# EAGLE design IBB v1.0 (EAGLE 7.5.0) (continued)
### Nets (continued)

### Notes on the sheet
- LEDs
- Router Connector | Sensor Connector
- LAN LED
- Programmable Button
- WAN LED
- POWER LED
- BEE Socket: 
  for BLE/GPRS/3G/4G/5G
- I/O, Connectors

## Sheet 5 of 5
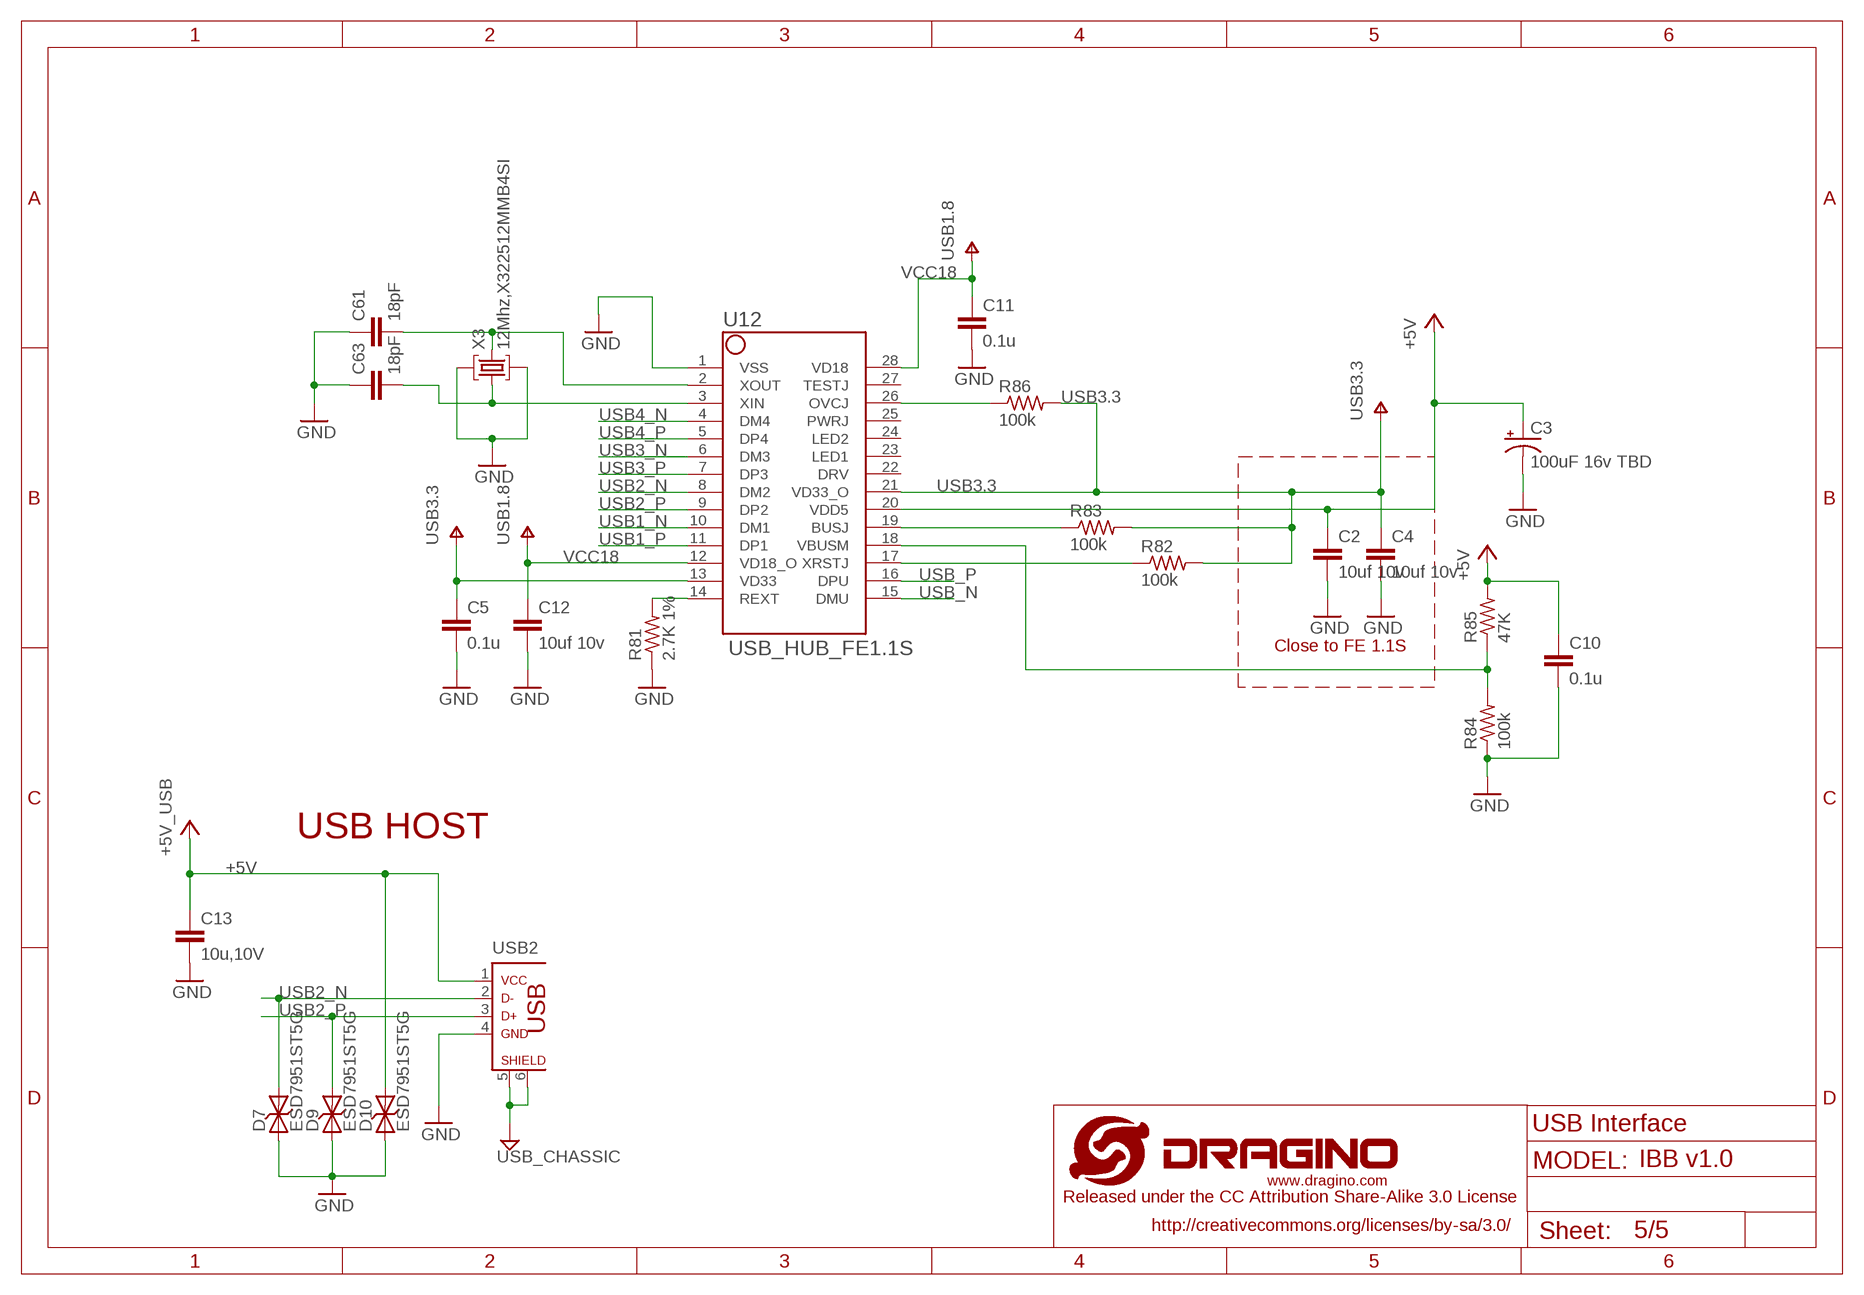
[diagram p4: schematic, sheet 5]

### Parts
C2  10uf 10v  C-EUC0603  [C0603]
C3  100uF 16v TBD  CPOL-USUD-6,3X5,8  [UD-6,3X5,8_NICHICON]
C4  10uf 10v  C-EUC0603  [C0603]
C5  0.1u  C-EUC0402  [C0402]
C10  0.1u  C-EUC0402  [C0402]
C11  0.1u  C-EUC0402  [C0402]
C12  10uf 10v  C-EUC0603  [C0603]
C13  10u,10V  C-EUC0805  [C0805]
C61  18pF  C-EUC0402  [C0402]
C63  18pF  C-EUC0402  [C0402]
D7  ESD7951ST5G  TVSSOD−923  [SOD−923]
D9  ESD7951ST5G  TVSSOD−923  [SOD−923]
D10  ESD7951ST5G  TVSSOD−923  [SOD−923]
R81  2.7K 1%  R-US_R0402  [R0402]
R82  100k  R-US_R0402  [R0402]
R83  100k  R-US_R0402  [R0402]
R84  100k  R-US_R0402  [R0402]
R85  47K  R-US_R0402  [R0402]
R86  100k  R-US_R0402  [R0402]
U12  USB_HUB_FE1.1S  [USB_HUB_FE1.1S]
USB2  USB_C42562  [USB_C42562]
X3  12Mhz,X322512MMB4SI  CRYSTAL  [SMARTPRJ_CRYSTAL-3.2-2.5]

### Nets
+5V: C2.1 C3.+ C10.1 C13.1 D10.P$2 R85.2 U12.20(VDD5) USB2.1 ; supply symbol labelled +5V_USB ; also sheet 2,4
CLK_N: C63.2 U12.3(XIN) X3.1(C1)
CLK_P: C61.2 U12.2(XOUT) X3.3(C2)
GND [gnd]: C2.2 C3.- C4.2 C5.2 C10.2 C11.2 C12.2 C13.2 C61.1 C63.1 D7.P$1 D9.P$1 D10.P$1 R81.1 R84.1 U12.1(VSS) USB2.4 X3.2(GND) X3.4(GND) ; also sheet 1,2,3,4
N$18: R86.1 U12.26(OVCJ)
N$109: R81.2 U12.14(REXT)
N$111: R82.1 U12.17(XRSTJ)
N$112: R83.1 U12.19(BUSJ)
N$113: R84.2 R85.1 U12.18(VBUSM)
USB1_N: U12.10(DM1) ; also sheet 4
USB1_P: U12.11(DP1) ; also sheet 4
USB2_N [usbtrace-4layer]: D7.P$2 U12.8(DM2) USB2.2
USB2_P [usbtrace-4layer]: D9.P$2 U12.9(DP2) USB2.3
USB3.3: C4.1 C5.1 R82.2 R83.2 R86.2 U12.13(VD33) U12.21(VD33_O)
USB3_N: U12.6(DM3) ; also sheet 4
USB3_P: U12.7(DP3) ; also sheet 4
USB4_N: U12.4(DM4)
USB4_P: U12.5(DP4)
USB_GND [gnd]: USB2.5 USB2.6 ; supply symbol labelled USB_CHASSIC
USB_N: U12.15(DMU) ; also sheet 1
USB_P: U12.16(DPU) ; also sheet 1
VCC18: C11.1 C12.1 U12.12(VD18_O) U12.28(VD18) ; supply symbol labelled USB1.8
Unconnected: U12.22(DRV) U12.23(LED1) U12.24(LED2) U12.25(PWRJ) U12.27(TESTJ)

### Notes on the sheet
- Close to FE 1.1S
- USB HOST
- USB Interface

## Power pins joined to a net without a drawn wire
OPTIONAL_ANT: U1.49(OPTIONAL_ANT)

## Library data of the parts
BEE-CON-1 BEE-CON-2 = dragino-passive:CON-10P: FEMALE HEADER
BEE-VIN USB3 = dragino:JP2E: JUMPER
C1 C6-C9 C13 C17 C19-C23 C33-C38 C52 C53 C55-C58 = dragino:C-EU: CAPACITOR, European symbol
C2 C4 C5 C10-C12 C15 C61 C63 = dragino-passive:C-EU: CAPACITOR, European symbol
C3 = dragino:CPOL-US: POLARIZED CAPACITOR, American symbol
C14 C18 = rcl:CPOL-US: POLARIZED CAPACITOR, American symbol
D7 D9 D10 = dragino:TVS: DIODE
F1 = dragino:FUSE: FUSE 5 x 20 mm
J1 = dragino:POWER_JACK: Power Jack This is the standard 5.5mm barrel jack for power. The PTH is the most common, proven, reliable, footprint. All others are experimental. The Slot footprint only works if the mill layer is transmitted to the PCB fab house so be warned. Spark Fun Electronics SKU : PRT-00119. Mating wall wart : TOL-00298 (and others)
J2 = dragino:ETHERNET_2PORT
L2 = dragino-passive:INDUCTOR: CHOKE U15
L4 L5 = inductor-neosid:BS: INDUCTOR nominal inductance, magnetically screened; OC_FARNELL: unknown; OC_NEWARK: unknown
L6 = dragino:INDUCTOR: CHOKE U15
LAN PWR SENSOR SYS WAN WIFI = dragino:LED: LED OSRAM: - CHIPLED LG R971, LG N971, LY N971, LG Q971, LY Q971, LO R971, LY R971 LH N974, LH R974 LS Q976, LO Q976, LY Q976 LO Q996 - Hyper CHIPLED LW Q18S LB Q993, LB Q99A, LB R99A - SideLED LS A670, LO A670, LY A670, LG A670, LP A670 LB A673, LV A673, LT A673, LW A673 LH A674 LY A675 LS A676, LA A676, LO A676, LY A676, LW A676 LS A679, LY A679, LG A679 - Hyper Micro SIDELED® LS Y876, LA Y876, LO Y876, LY Y876 LT Y87S - SmartLED LW L88C, LW L88S LB L89C, LB L89S, LG L890 LS L89K, LO L89K, LY L89K LS L896, LA L896, LO L896, LY L896 - TOPLED LS T670, LO T670, LY T670, LG T670, LP T670 LSG T670, LSP T670, LSY T670, LOP T670, LYG T670 LG T671, LOG T671, LSG T671 LB T673, LV T673, LT T673, LW T673 LH T674 LS T676, LA T676, LO T676, LY T676, LB T676, LH T676, LSB T676, LW T676 LB T67C, LV T67C, LT T67C, LS T67K, LO T67K, LY T67K, LW E67C LS E67B, LA E67B, LO E67B, LY E67B, LB E67C, LV E67C, LT E67C LW T67C LS T679, LY T679, LG T679 LS T770, LO T770, LY T770, LG T770, LP T770 LB T773, LV T773, LT T773, LW T773 LH T774 LS E675, LA E675, LY E675, LS T675 LS T776, LA T776, LO T776, LY T776, LB T776 LHGB T686 LT T68C, LB T68C - Hyper Mini TOPLED® LB M676 - Mini TOPLED Santana® LG M470 LS M47K, LO M47K, LY M47K Source: http://www.osram.convergy.de LUXEON: - LUMILED® LXK2-PW12-R00, LXK2-PW12-S00, LXK2-PW14-U00, LXK2-PW14-V00 LXK2-PM12-R00, LXK2-PM12-S00, LXK2-PM14-U00 LXK2-PE12-Q00, LXK2-PE12-R00, LXK2-PE12-S00, LXK2-PE14-T00, LXK2-PE14-U00 LXK2-PB12-K00, LXK2-PB12-L00, LXK2-PB12-M00, LXK2-PB14-N00, LXK2-PB14-P00, LXK2-PB14-Q00 LXK2-PR12-L00, LXK2-PR12-M00, LXK2-PR14-Q00, LXK2-PR14-R00 LXK2-PD12-Q00, LXK2-PD12-R00, LXK2-PD12-S00 LXK2-PH12-R00, LXK2-PH12-S00 LXK2-PL12-P00, LXK2-PL12-Q00, LXK2-PL12-R00 Source: www.luxeon.com KINGBRIGHT: KA-3528ASYC Source: www.kingbright.com
Q1 = dragino:NMOSFET: MOS FET; OC_FARNELL: unknown; OC_NEWARK: unknown
R1-R27 R29-R37 R39-R41 R46 R55-R57 R81-R86 = dragino:R-US_: RESISTOR, American symbol
ROUTER = dragino:MA08-2: PIN HEADER; OC_FARNELL: unknown; OC_NEWARK: unknown
S1 = dragino:PUSH_SWITCH: PUSH SWITCH ITT-Cannon-Cannon
SCREW = dragino:MA07-2: PIN HEADER; OC_FARNELL: unknown; OC_NEWARK: unknown
T1 = dragino:RJ45_TRANSFORMER_HST2038DR
T4 = zetex:NPNSOT323: NPN TRANSISTOR; MPN: DSS4160U-7; OC_FARNELL: 1710696; OC_NEWARK: 25R4558
U1 = dragino:DRAGINO_HE-4025
U2 U3 = dragino:RT7272
U5 = linear:MC33269ST*: Adjustable Output Low Dropout Voltage Regulator 800 mA Source: http://www.onsemi.com/pub/Collateral/MC33269-D.PDF
U6 = dragino:NC7WZ125: 3 state buffer: http://www.fairchildsemi.com/ds/NC/NC7WZ125.pdf
U12 = dragino:USB_HUB_FE1.1S
USB2 = dragino-passive:USB_C42562
X1 X2 = con-phoenix-350:1751293: MKDS 1/ 7-3,5 Printklemme Nennstrom: 10 A Bemessungsspannung: 160 V Raster: 3,5 mm Polzahl: 7 Montageart: Löten Anschlussart: Schraubanschluss Anschlussrichtung vom Leiter zur Platine: 0° Source: http://eshop.phoenixcontact.com .. 1751293.pdf; OC_FARNELL: unknown; OC_NEWARK: unknown
X3 = dragino-passive:CRYSTAL

## Net classes
0 default: clearance 0.205 mm
1 power: width 0.61 mm, drill 0.406 mm, clearance 0.254 mm
2 gnd: width 0.305 mm, drill 0.33 mm, clearance 0.254 mm
3 usbvcc: width 0.508 mm, drill 0.61 mm, clearance 0.254 mm
4 aref: width 0.406 mm, drill 0.61 mm, clearance 0.254 mm
6 usbtrace-4layer: width 0.191 mm, clearance 0.203 mm

## Board
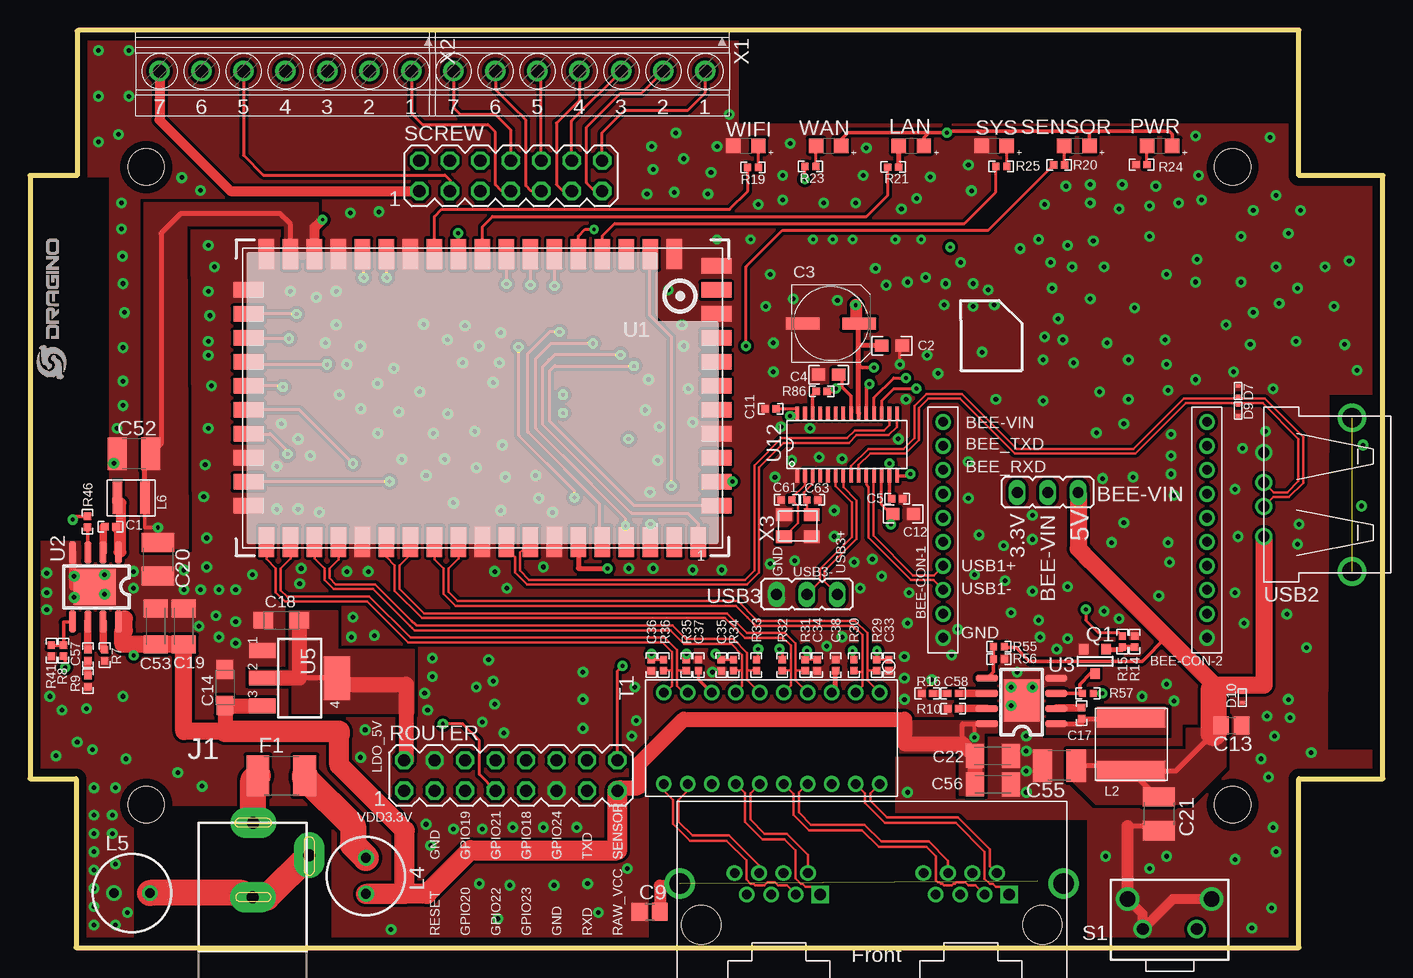
[diagram p5: board, top side]
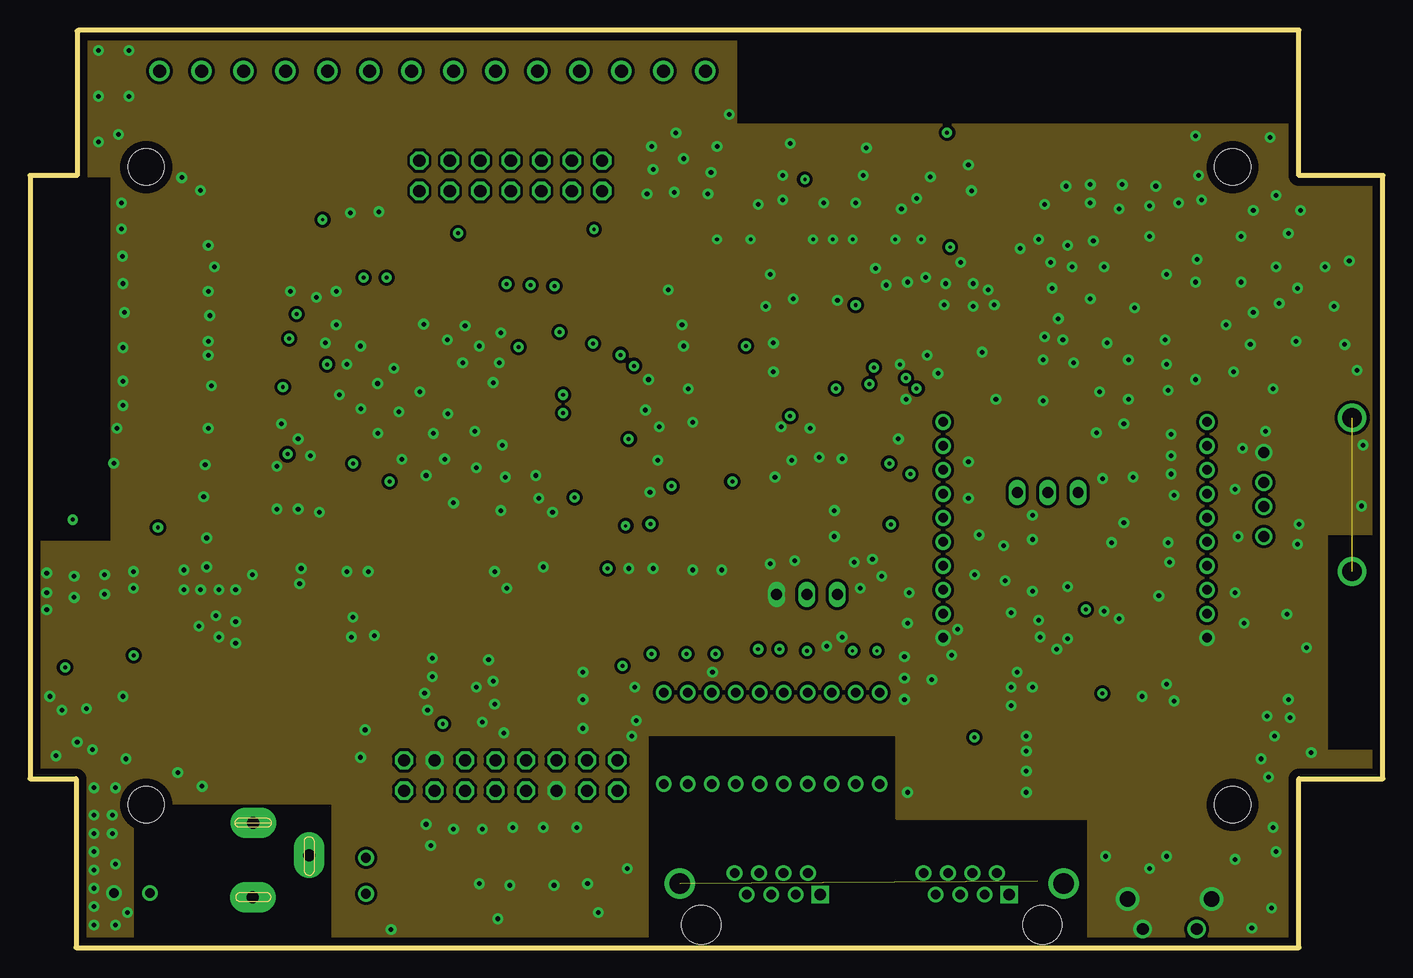
[diagram p6: board, inner layer Route2]
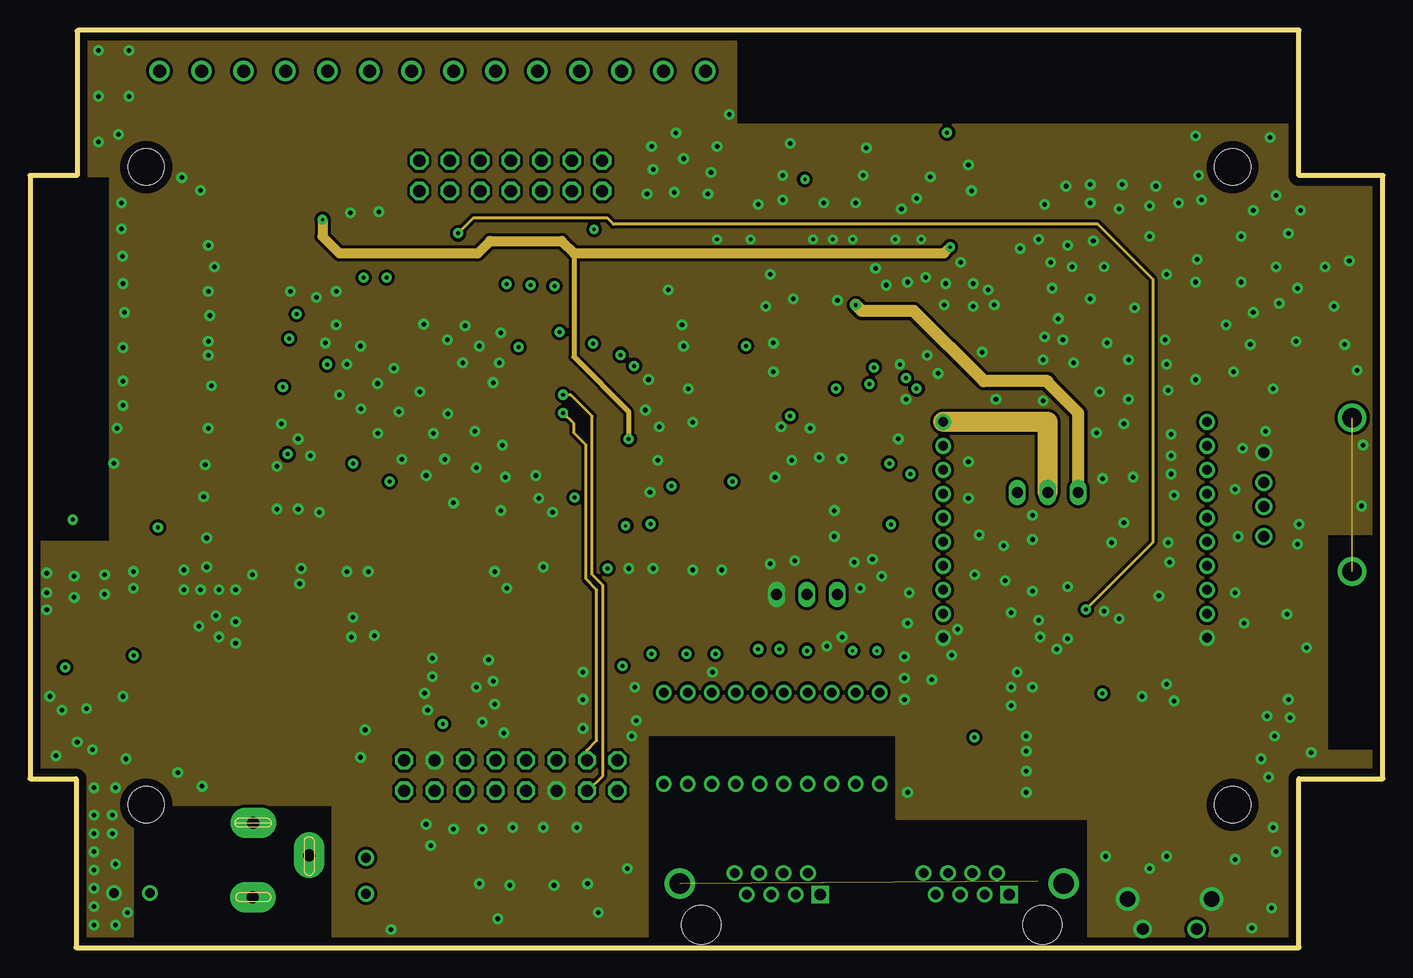
[diagram p7: board, inner layer Route15]
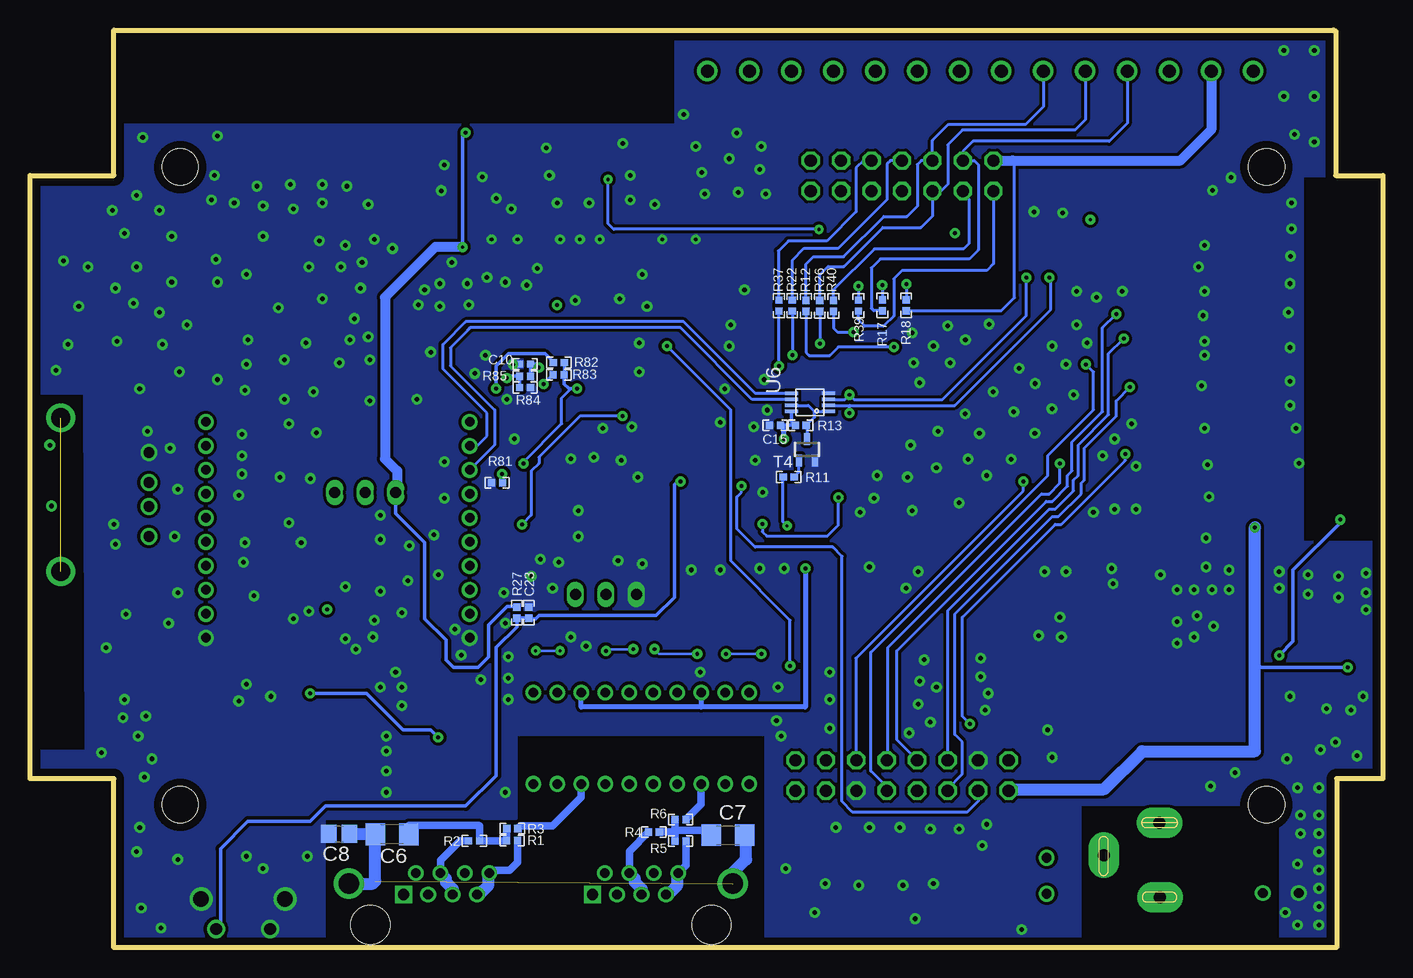
[diagram p8: board, bottom side, seen from below]

Size 112.78 x 76.5 mm. Coordinates in mm from the lower left corner, seen from the top.
Outline: 105.79,0 105.79,14.08 112.78,14.08 112.78,64.37 105.79,64.37 105.79,76.5 4.1,76.5 4.1,76.44 3.94,76.44 3.94,64.37 0,64.37 0,14.08 3.85,14.08 3.85,0 105.79,0
Copper layers (1*2+15*16): Top 0.035mm / dielectric 1.5mm / Route2 0.035mm / dielectric 0.15mm / Route15 0.035mm / dielectric 0.2mm / Bottom 0.035mm
Design rules "default *": minimum track width 5mil, minimum drill 10mil, track to track 8mil, track to pad 8mil, pad to pad 8mil, via to via 10mil, smd to smd 8mil, copper to edge 26mil, drill to drill 10mil, minimum pad ring 10mil, minimum via ring 10mil, stop-mask expansion 1mil, vias tented up to drill 30mil, thermal gap 10mil
Holes 3 mm at 100.25,11.91 9.7,11.91 9.7,65.08 100.25,65.08
bRestrict: area 98.9,70.3 to 105,75.9

### Footprints (pad centres in the part's own frame; a part is rotated, then mirrored left to right if it is on the bottom)
10P-2.0MM = drill 0.8 pad 1.27: 1 0,9; 2 0,7; 3 0,5; 4 0,3; 5 0,1; 6 0,-1; 7 0,-3; 8 0,-5; 9 0,-7; 10 0,-9
JP2 = drill 0.914 long: 1 -2.54,0; 2 0,0; 3 2.54,0
C0402 = smd 0.61 x 0.61: 1 -0.457,0; 2 0.457,0
C0603 = smd 1.1 x 1: 1 -0.85,0; 2 0.85,0
UD-6,3X5,8_NICHICON = smd 2.8 x 1: + 2.35,0; - -2.35,0
C1206 = smd 1.6 x 1.8: 1 -1.4,0; 2 1.4,0
C0805 = smd 1.3 x 1.5: 1 -0.85,0; 2 0.85,0
SMC_A = smd 1.6 x 1.4: + -1.5,0; - 1.5,0
C1206K = smd 1.5 x 2: 1 -1.5,0; 2 1.5,0
C1210 = smd 1.6 x 2.7: 1 -1.4,0; 2 1.4,0
SOD−923 = smd 0.3 x 0.4: P$1 -0.45,0; P$2 0.45,0
L1812 = smd 1.9 x 3.4: 1 -1.95,0; 2 1.95,0
POWER_JACK_SLOT = drill 1 pad 2.54 long: GND@1 0,0; GND@2 4.7,3.5; PWR 0.04,6.2
ETHERNET-1X2 = drill 0.94 pad 1.27 square: 1-1 4.305,-2.54; 2-1 -11.445,-2.54 | drill 0.8: 1-2 5.325,-4.32; 1-3 6.345,-2.54; 1-4 7.365,-4.32; 1-5 8.385,-2.54; 1-6 9.405,-4.32; 1-7 10.425,-2.54; 1-8 11.445,-4.32; 2-2 -10.425,-4.32; 2-3 -9.405,-2.54; 2-4 -8.385,-4.32; 2-5 -7.365,-2.54; 2-6 -6.345,-4.32; 2-7 -5.325,-2.54; 2-8 -4.305,-4.32 | drill 1.7: S1 16,-3.43; S2 -16,-3.43 | hole 3.25: -14.225,0; 14.225,0
SWPA6028S = smd 5.7 x 1.7: P$1 0,2.25; P$2 0,-2.25
BS11 = drill 0.8: 1 -1.5,0; 2 1.5,0
SWPA3010S = smd 0.8 x 2.7: P$1 -1.15,0; P$2 1.15,0
CHIP-LED0805 = smd 1.2 x 1.2: A 0,-1.05; C 0,1.05
SOT-23 = smd 0.787 x 0.889: 1 0,-1.016; 2 -0.95,1.016; 3 0.95,1.016
R0402 = smd 0.61 x 0.61: 1 -0.457,0; 2 0.457,0
MA08-2 = drill 1.016 octagon: 1 -8.89,-1.27; 2 -8.89,1.27; 3 -6.35,-1.27; 4 -6.35,1.27; 5 -3.81,-1.27; 6 -3.81,1.27; 7 -1.27,-1.27; 8 -1.27,1.27; 9 1.27,-1.27; 10 1.27,1.27; 11 3.81,-1.27; 12 3.81,1.27; 13 6.35,-1.27; 14 6.35,1.27; 15 8.89,-1.27; 16 8.89,1.27
SWITCH_6X6X5 = drill 0.991 pad 1.524: 1 -2.25,0; 2 2.25,0 | drill 1.295 pad 1.905: 3 3.5,2.5; 4 -3.5,2.5
MA07-2 = drill 1.016 octagon: 1 -7.62,-1.27; 2 -7.62,1.27; 3 -5.08,-1.27; 4 -5.08,1.27; 5 -2.54,-1.27; 6 -2.54,1.27; 7 0,-1.27; 8 0,1.27; 9 2.54,-1.27; 10 2.54,1.27; 11 5.08,-1.27; 12 5.08,1.27; 13 7.62,-1.27; 14 7.62,1.27
RIONET_H2038 = drill 0.8: 1 -3.81,9; 2 -3.81,7; 3 -3.81,5; 4 -3.81,3; 5 -3.81,1; 6 -3.81,-1; 7 -3.81,-3; 8 -3.81,-5; 9 -3.81,-7; 10 -3.81,-9; 11 3.81,-9; 12 3.81,-7; 13 3.81,-5; 14 3.81,-3; 15 3.81,-1; 16 3.81,1; 17 3.81,3; 18 3.81,5; 19 3.81,7; 20 3.81,9
SOT323 = smd 0.5 x 1: 1 0,0.9; 2 -0.65,-0.9; 3 0.65,-0.9
DRAGINO_HE-4025 = smd 1.3 x 2.5: 1 -18,12; 2 -16,12; 3 -14,12; 4 -12,12; 5 -10,12; 6 -8,12; 7 -6,12; 8 -4,12; 9 -2,12; 10 0,12; 11 2,12; 12 4,12; 13 6,12; 14 8,12; 15 10,12; 16 12,12; 17 14,12; 18 16,12; 19 18,12; 30 18,-12; 31 16,-12; 32 14,-12; 33 12,-12; 34 10,-12; 35 8,-12; 36 6,-12; 37 4,-12; 38 2,-12; 39 0,-12; 40 -2,-12; 41 -4,-12; 42 -6,-12; 43 -8,-12; 44 -10,-12; 45 -12,-12; 46 -14,-12; 47 -16,-12 | smd 2.5 x 1.3: 20 19.5,9; 21 19.5,7; 22 19.5,5; 23 19.5,3; 24 19.5,1; 25 19.5,-1; 26 19.5,-3; 27 19.5,-5; 28 19.5,-7; 29 19.5,-9; 48 -19.5,-11; 49 -19.5,-9; 50 -19.5,-7; 51 -19.5,-5; 52 -19.5,-3; 53 -19.5,-1; 54 -19.5,1; 55 -19.5,3; 56 -19.5,5; 57 -19.5,7; 58 -19.5,9
RT8250-SOP8 = smd 1.88 x 0.61: 1 -1.219,0; 2 -1.219,-1.27; 3 -1.219,-2.54; 4 -1.219,-3.81; 5 4.547,-3.81; 6 4.547,-2.54; 7 4.547,-1.27; 8 4.547,0 | smd 2.997 x 3.505: 9 1.651,-1.956
SOT223 = smd 1.219 x 2.235: 1 -2.311,-3.099; 2 0,-3.099; 3 2.311,-3.099 | smd 3.6 x 2.2: 4 0,3.099
US8 = smd 0.3 x 1.1: 1 -0.75,-1.55; 2 -0.25,-1.55; 3 0.25,-1.55; 4 0.75,-1.55; 5 0.75,1.55; 6 0.25,1.55; 7 -0.25,1.55; 8 -0.75,1.55
USB_HUB_FE1.1S = smd 0.3 x 1.1: 1 -4.16,-2.6; 2 -3.52,-2.6; 3 -2.88,-2.6; 4 -2.24,-2.6; 5 -1.6,-2.6; 6 -0.96,-2.6; 7 -0.32,-2.6; 8 0.32,-2.6; 9 0.96,-2.6; 10 1.6,-2.6; 11 2.24,-2.6; 12 2.88,-2.6; 13 3.52,-2.6; 14 4.16,-2.6; 15 4.16,2.62; 16 3.52,2.62; 17 2.88,2.62; 18 2.24,2.62; 19 1.6,2.62; 20 0.96,2.62; 21 0.32,2.62; 22 -0.32,2.62; 23 -0.96,2.62; 24 -1.6,2.62; 25 -2.24,2.62; 26 -2.88,2.62; 27 -3.52,2.62; 28 -4.16,2.62
USB_C42562 = drill 0.9: 1 -3.5,5.29; 2 -1,5.29; 3 1,5.29; 4 3.5,5.29 | drill 1.6: 5 -6.4,-2.06; 6 6.4,-2.06
1751293 = drill 1.1 pad 1.7: 1 -10.5,-0.1; 2 -7,-0.1; 3 -3.5,-0.1; 4 0,-0.1; 5 3.5,-0.1; 6 7,-0.1; 7 10.5,-0.1
SMARTPRJ_CRYSTAL-3.2-2.5 = smd 1.3 x 1.05: 1 -1.15,-0.925; 2 1.15,-0.925; 3 1.15,0.925; 4 -1.15,0.925

### Placement (x,y rotation side)
BEE-CON-1  76.12,34.82 0 top
BEE-CON-2  98.12,34.82 180 top
BEE-VIN  84.84,37.96 0 top
C1  6.71,35.08 0 top
C2  71.86,50.17 0 top
C3  66.78,52.03 0 top
C4  66.57,47.76 180 top
C5  72.29,37.42 0 top
C6  82.59,9.44 180 bottom
C7  54.59,9.37 0 bottom
C8  87,9.48 0 bottom
C9  51.67,2.97 0 top
C10  71.5,48.65 180 bottom
C11  61.75,44.91 180 top
C12  72.8,36.15 0 top
C13  100.15,18.52 0 top
C14  16.26,21.7 90 top
C15  50.67,43.54 180 bottom
C17  87.66,19.54 270 top
C18  20.95,27.29 180 top
C19  12.83,26.78 90 top
C20  10.67,32.37 270 top
C21  94.11,11.16 270 top
C22  80.26,15.98 0 top
C23  71.2,27.92 90 bottom
C33  71.6,23.55 270 top
C34  65.64,23.55 270 top
C35  57.63,23.55 270 top
C36  51.79,23.55 270 top
C37  55.73,23.55 90 top
C38  67.16,23.55 90 top
C52  8.66,41.16 180 top
C53  10.46,26.78 90 top
C55  85.8,15.17 180 top
C56  80.29,13.6 0 top
C57  4.83,24.37 90 top
C58  76.96,21.19 0 top
C61  63.07,37.32 0 top
C63  65.23,37.32 180 top
D7  100.71,46.39 270 top
D9  100.71,44.79 90 top
D10  101.07,20.86 90 top
F1  20.95,14.33 0 top
J1  18.58,4.21 0 top
J2  70.18,1.89 180 top
L2  91.8,16.95 0 top
L4  28.02,5.98 90 top
L5  8.51,4.55 0 top
L6  8.43,37.5 0 top
LAN  73.47,66.84 90 top
PWR  94.17,66.84 90 top
Q1  88.77,23.86 0 top
R1  72.59,8.91 0 bottom
R2  75.75,8.9 180 bottom
R3  72.57,9.91 180 bottom
R4  60.76,9.63 180 bottom
R5  58.55,8.87 0 bottom
R6  58.55,10.67 180 bottom
R7  6.22,24.37 270 top
R8  2.79,24.75 270 top
R9  4.83,22.21 90 top
R10  76.96,19.92 180 top
R11  49.53,39.23 180 bottom
R12  48.08,53.5 270 bottom
R13  48.51,43.54 180 bottom
R14  92.08,25.51 270 top
R15  91.06,25.51 270 top
R16  74.8,21.19 180 top
R17  41.71,53.55 90 bottom
R18  39.73,53.55 90 bottom
R19  60.27,65.03 0 top
R20  85.78,65.24 0 top
R21  71.97,65.07 0 top
R22  49.23,53.53 270 bottom
R23  65.06,65.13 0 top
R24  92.66,65.27 0 top
R25  80.97,65.13 0 top
R26  46.94,53.5 90 bottom
R27  72.19,27.92 270 bottom
R29  70.59,23.55 90 top
R30  68.68,23.55 90 top
R31  64.62,23.55 90 top
R32  62.71,23.55 90 top
R33  60.56,23.55 90 top
R34  58.65,23.55 90 top
R35  54.71,23.55 90 top
R36  52.81,23.55 90 top
R37  50.34,53.53 270 bottom
R39  43.71,53.53 270 bottom
R40  45.8,53.5 90 bottom
R41  1.78,24.75 90 top
R46  4.8,35.49 270 top
R55  80.77,25.08 0 top
R56  80.77,24.04 180 top
R57  88.19,21.19 0 top
R81  73.84,38.74 0 bottom
R82  68.68,48.78 0 bottom
R83  68.71,47.76 0 bottom
R84  71.5,46.69 180 bottom
R85  71.5,47.63 0 bottom
R86  65.99,46.36 0 top